# EasyEDA Pro project Q's HelloWorld KeyBoard.eprj, schematic SCH 主体Type-C接口板
Create Date: 2022-10-16; Page Name: P1; Project Name: Q's HelloWorld KeyBoard; Schematic Name: SCH 主体Type-C接口板; Update Date: 2022-10-16; Company: 嘉立创EDA; Page Size: A5; Version: V1.0
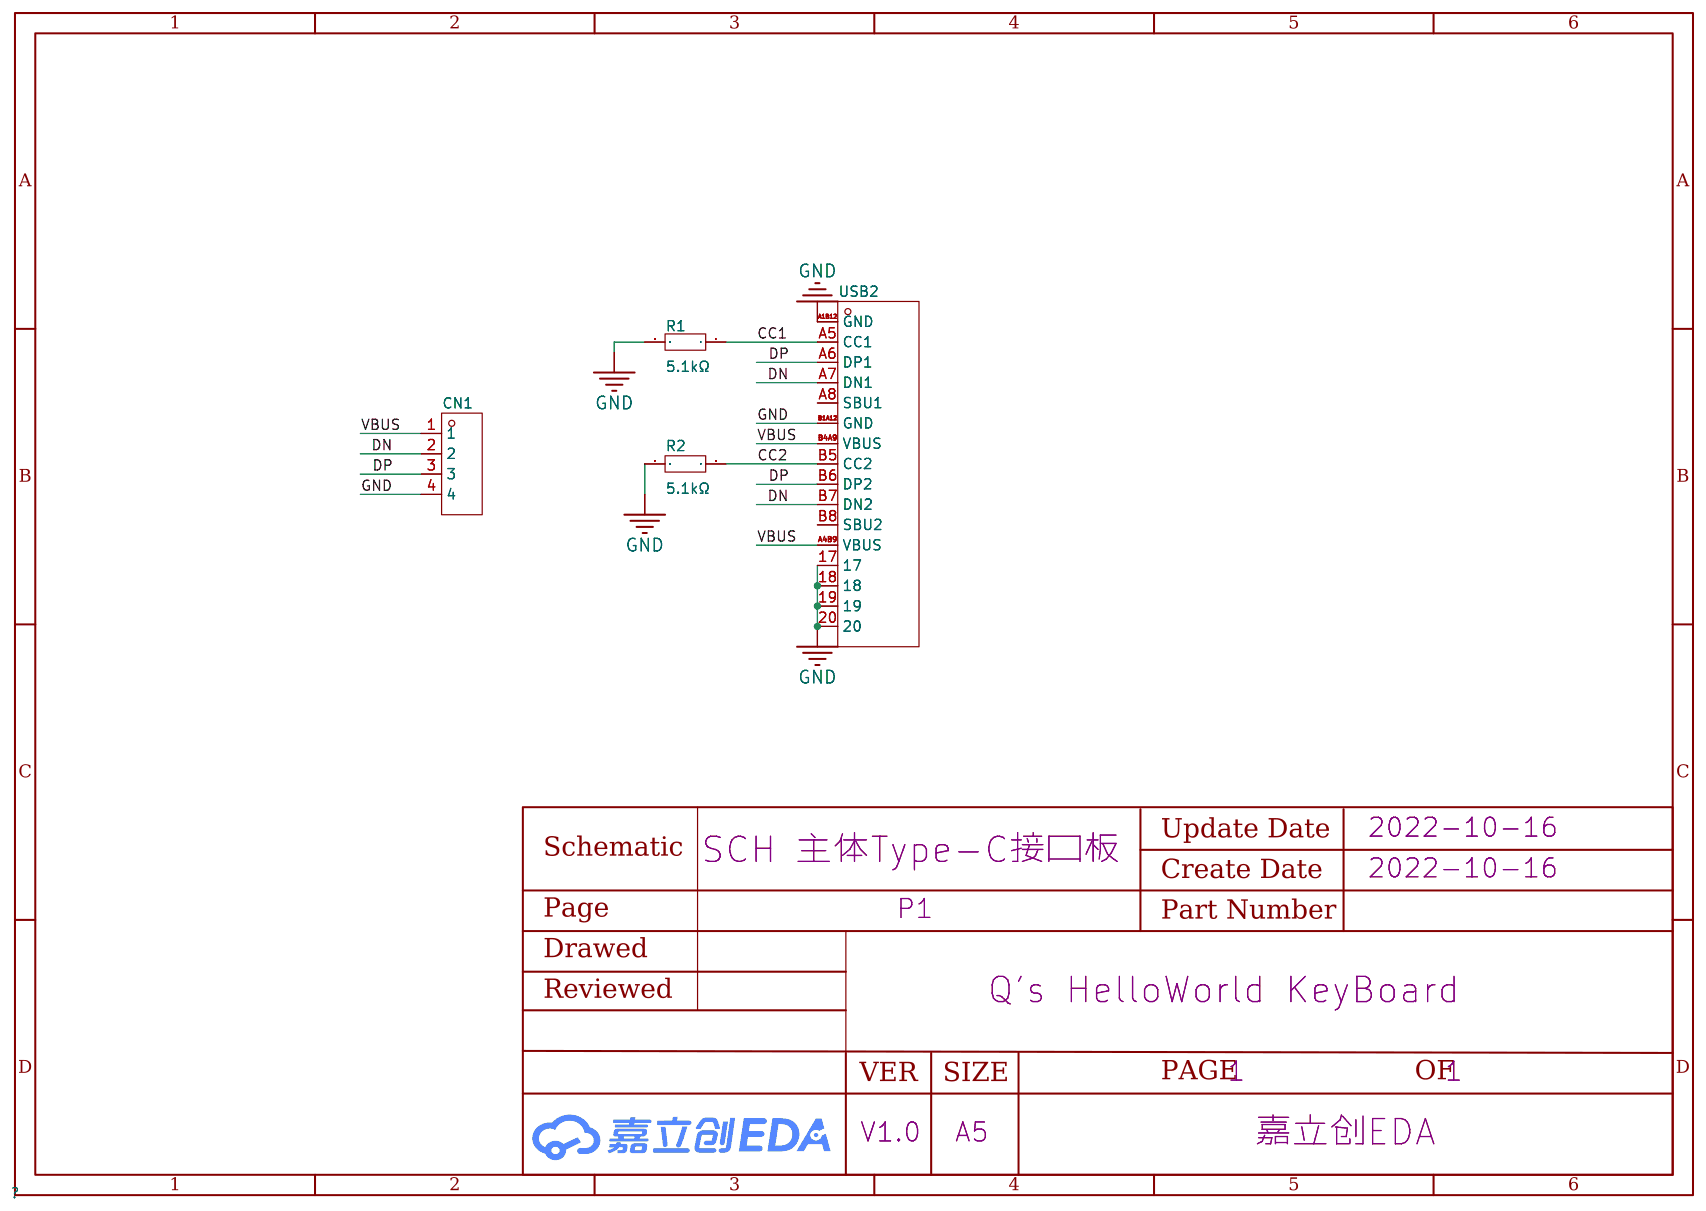
[diagram p1: schematic sheet]

## Parts
CN1  1125-1104G0Z135CR01  [CONN-SMD_1125-1104G0Z135CR01]
R1  5.1kΩ  [R0402]
R2  5.1kΩ  [R0402]
USB2  TYPE-C-2.0-16PIN-SMT-3-OR  [USB-SMD_TYPE-C16PIN-1]

## Library data of the parts
CN1 = 1125-1104G0Z135CR01: 间距:2.54mm;总PIN位数:4;排数:1;插针结构:1x4P;行距:-;安装类型:卧贴;圆针/方针:方针;额定电流:3A;额定电压:-;配合针长度:6mm;塑高:2.5mm;端接针长度:-;工作温度范围:-40~+105;颜色:黑色;; LCSC Part Name: 2.54mm 1x4P; Supplier Part: C721862; Manufacturer: Wcon(维峰电子); Supplier Footprint: SMD,P=2.54mm; JLCPCB Part Class: Extended Part; Datasheet: https://atta.szlcsc.com/upload/public/pdf/source/20200814/C721858_065EF9A46C6CEDE5E49F8CC6A7E28DB2.pdf; Supplier: LCSC; Pitch: 2.54mm; Number of Pins: 4; Number of Rows: 1; Pin Structure: 1x4P; Mounting Type: 卧贴; Circluar Pins/Square Pins: 方针; Current Rating (Max): 3A; Length of Mating Pin: 6mm; Insulation Height: 2.5mm; Operating Temperature Range: -40~+105; Color: 黑色
R1 R2 = RMC04025.1K1%N: 阻值:5.1kΩ;精度:±1%;功率:62.5mW;; LCSC Part Name: 5.1kΩ ±1% 62.5mW; Supplier Part: C325521; Manufacturer: Tyohm(幸亚电阻); Supplier Footprint: 0402; JLCPCB Part Class: Extended Part; Datasheet: https://atta.szlcsc.com/upload/public/pdf/source/20190115/C325521_1EC5F156994D781C7E2B08432302F19F.pdf; Supplier: LCSC; Tolerance: ±1%; Power(Watts): 62.5mW
USB2 = TYPE-C-2.0-16PIN-SMT-3-OR: 连接器类型:Type-C;标准:USB 2.0;公母:母座;触点数量:16;端口数量:1;安装方式:卧贴;额定电流 - 电源:5A;工作温度范围:-30~+85;; LCSC Part Name: Type-C 母座 卧贴; Supplier Part: C2987387; Manufacturer: CIKI(皓富); Supplier Footprint: SMD; JLCPCB Part Class: Extended Part; Datasheet: https://atta.szlcsc.com/upload/public/pdf/source/20220407/C019AFF2D27CFCDD341E74F7831BCFEE.pdf; Supplier: LCSC; Connector Type: Type-C; Standard: USB 2.0; Gender: 母座; Number of Contacts: 16; Number of Ports: 1; Mounting Style: 卧贴; Current Rating - Power (Max): 5A; Operating Temperature Range: -30~+85

## Nets
GND: CN1.4 R1.2 R2.1 USB2.17 USB2.18 USB2.19 USB2.20 USB2.A1B12(GND) USB2.B1A12(GND)
VBUS: CN1.1 USB2.A4B9(VBUS) USB2.B4A9(VBUS)
CC1: R1.1 USB2.A5(CC1)
CC2: R2.2 USB2.B5(CC2)
DN: CN1.2 USB2.A7(DN1) USB2.B7(DN2)
DP: CN1.3 USB2.A6(DP1) USB2.B6(DP2)

Not connected (* = marked no-connect by the designer): USB2 A8(SBU1) B8(SBU2)
